# Altium schematic sheet phototransistors.SchDoc: Phototransostors (part 3 of 3)
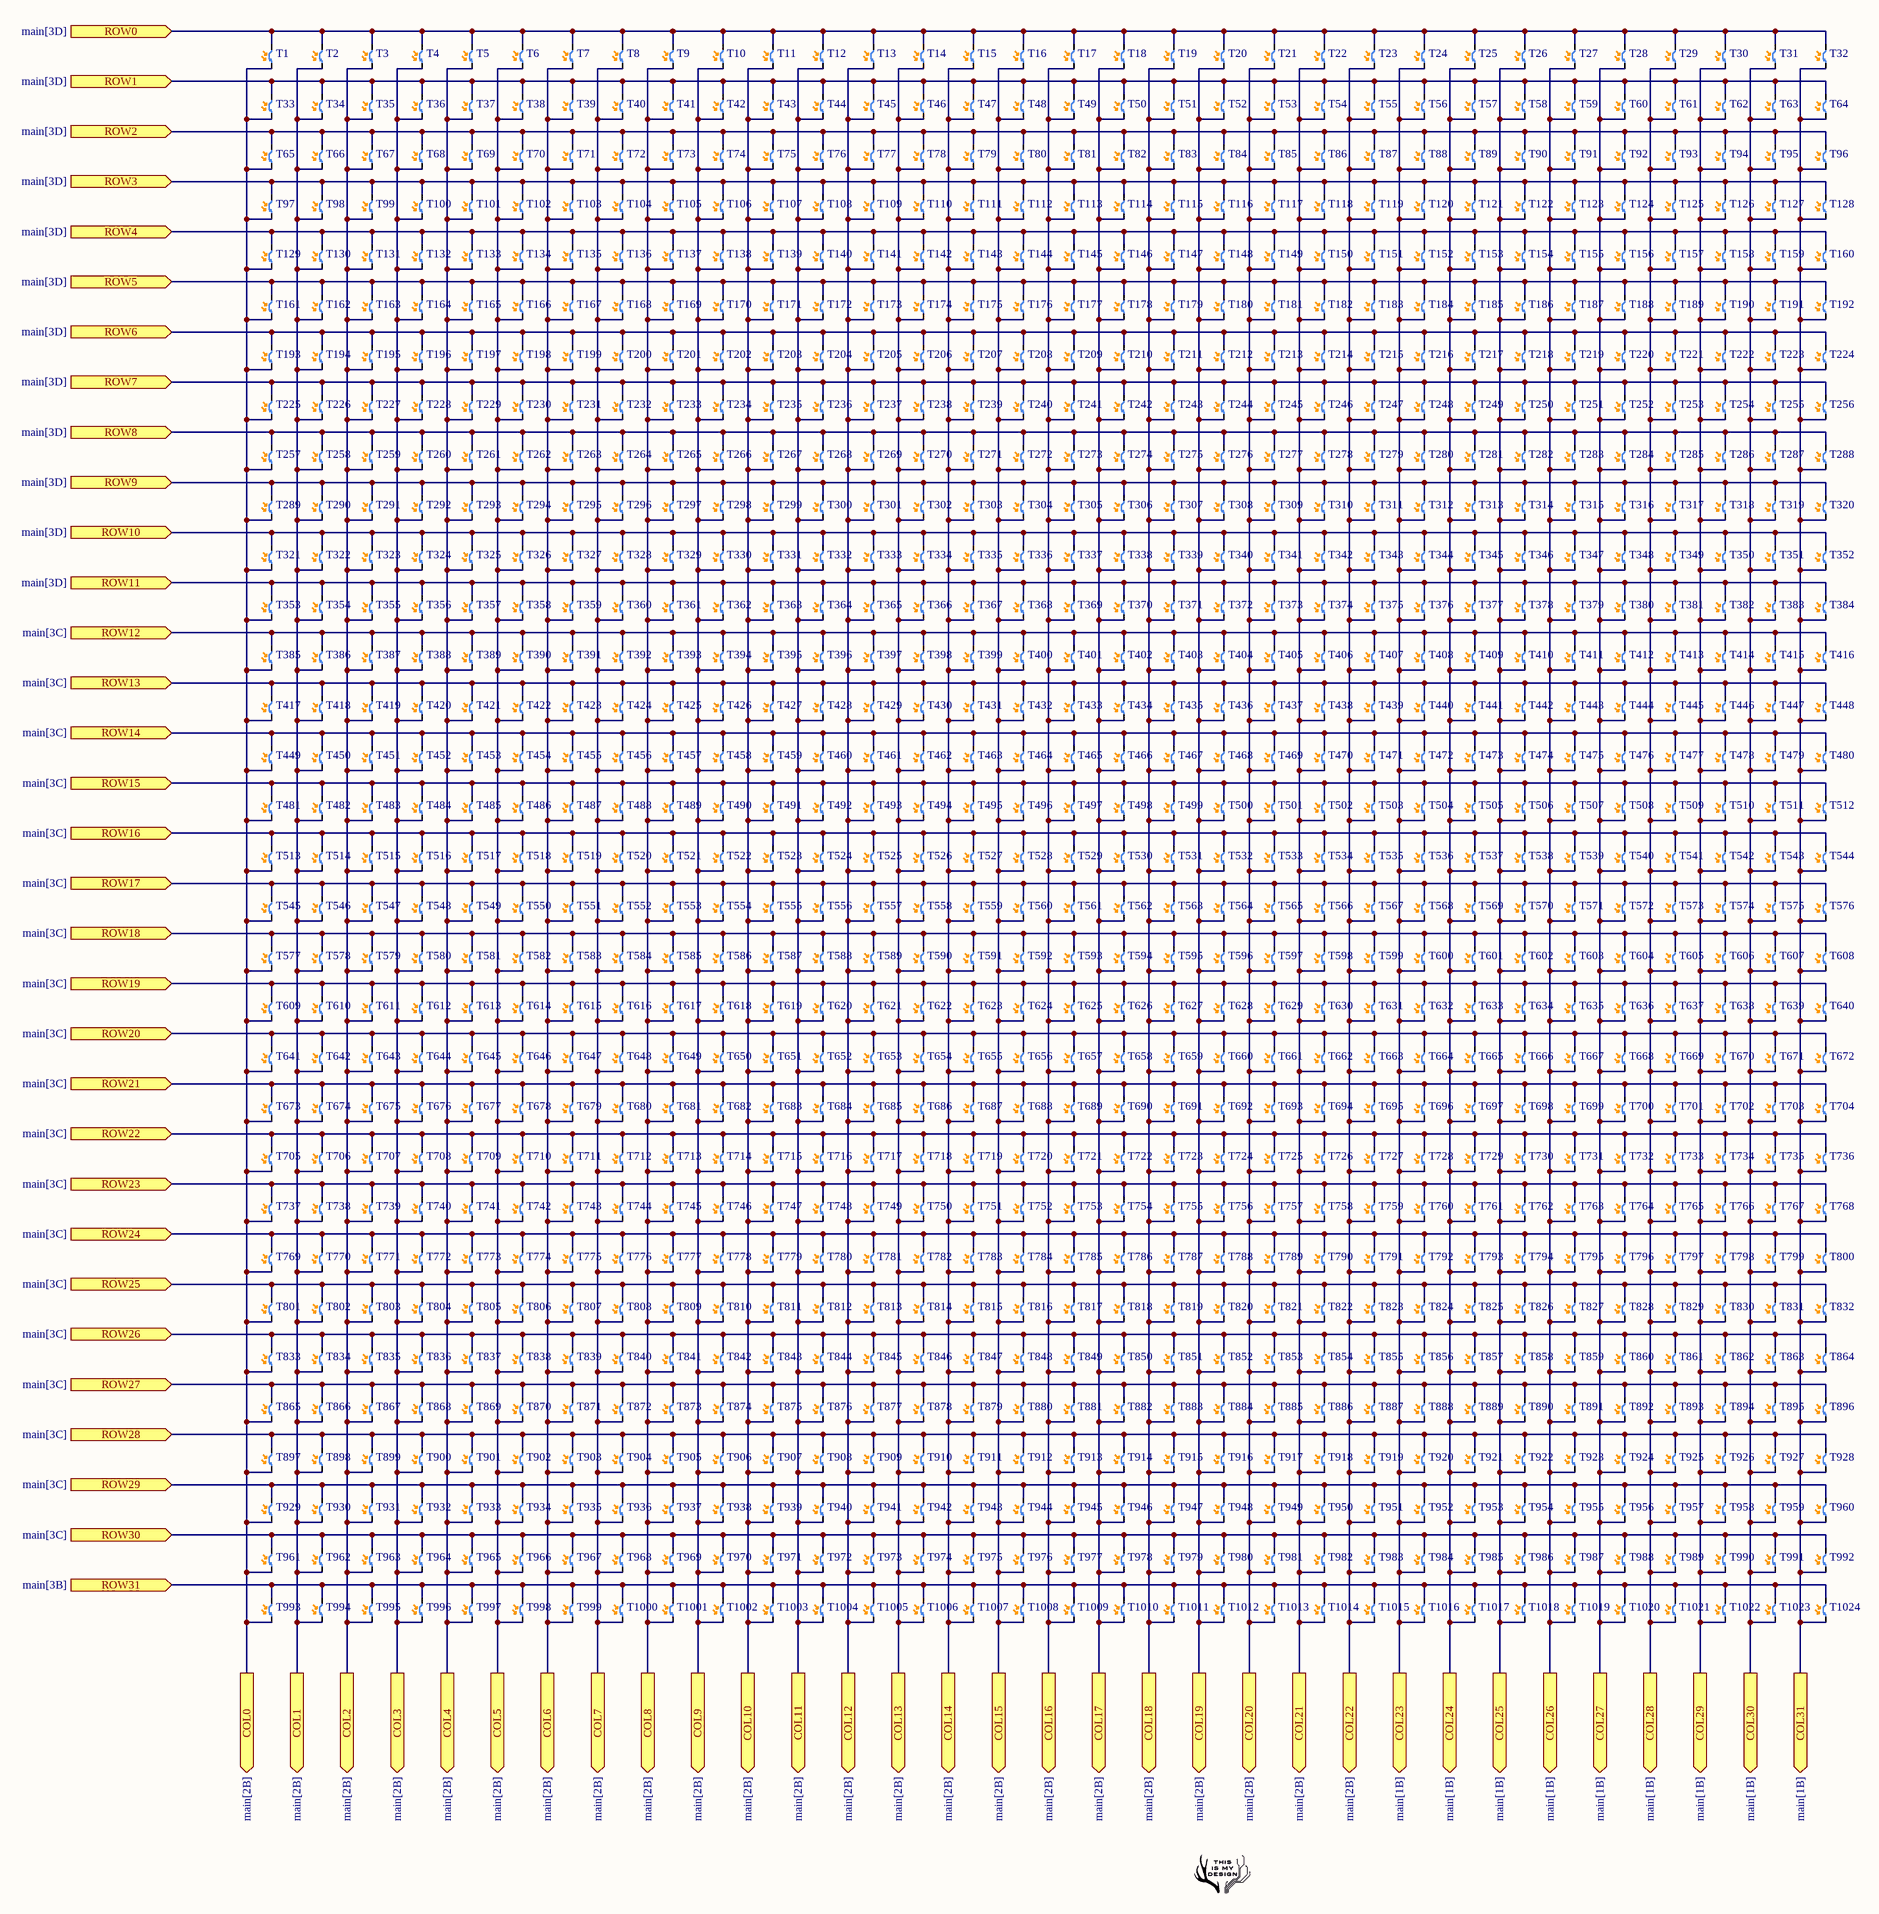
[diagram p2: phototransistors.SchDoc]

## Parts (continued)
T822  B19H1PT--H9C000214U1930  [LED0603W]  (value not drawn)
T823  B19H1PT--H9C000214U1930  [LED0603W]  (value not drawn)
T824  B19H1PT--H9C000214U1930  [LED0603W]  (value not drawn)
T825  B19H1PT--H9C000214U1930  [LED0603W]  (value not drawn)
T826  B19H1PT--H9C000214U1930  [LED0603W]  (value not drawn)
T827  B19H1PT--H9C000214U1930  [LED0603W]  (value not drawn)
T828  B19H1PT--H9C000214U1930  [LED0603W]  (value not drawn)
T829  B19H1PT--H9C000214U1930  [LED0603W]  (value not drawn)
T830  B19H1PT--H9C000214U1930  [LED0603W]  (value not drawn)
T831  B19H1PT--H9C000214U1930  [LED0603W]  (value not drawn)
T832  B19H1PT--H9C000214U1930  [LED0603W]  (value not drawn)
T833  B19H1PT--H9C000214U1930  [LED0603W]  (value not drawn)
T834  B19H1PT--H9C000214U1930  [LED0603W]  (value not drawn)
T835  B19H1PT--H9C000214U1930  [LED0603W]  (value not drawn)
T836  B19H1PT--H9C000214U1930  [LED0603W]  (value not drawn)
T837  B19H1PT--H9C000214U1930  [LED0603W]  (value not drawn)
T838  B19H1PT--H9C000214U1930  [LED0603W]  (value not drawn)
T839  B19H1PT--H9C000214U1930  [LED0603W]  (value not drawn)
T840  B19H1PT--H9C000214U1930  [LED0603W]  (value not drawn)
T841  B19H1PT--H9C000214U1930  [LED0603W]  (value not drawn)
T842  B19H1PT--H9C000214U1930  [LED0603W]  (value not drawn)
T843  B19H1PT--H9C000214U1930  [LED0603W]  (value not drawn)
T844  B19H1PT--H9C000214U1930  [LED0603W]  (value not drawn)
T845  B19H1PT--H9C000214U1930  [LED0603W]  (value not drawn)
T846  B19H1PT--H9C000214U1930  [LED0603W]  (value not drawn)
T847  B19H1PT--H9C000214U1930  [LED0603W]  (value not drawn)
T848  B19H1PT--H9C000214U1930  [LED0603W]  (value not drawn)
T849  B19H1PT--H9C000214U1930  [LED0603W]  (value not drawn)
T850  B19H1PT--H9C000214U1930  [LED0603W]  (value not drawn)
T851  B19H1PT--H9C000214U1930  [LED0603W]  (value not drawn)
T852  B19H1PT--H9C000214U1930  [LED0603W]  (value not drawn)
T853  B19H1PT--H9C000214U1930  [LED0603W]  (value not drawn)
T854  B19H1PT--H9C000214U1930  [LED0603W]  (value not drawn)
T855  B19H1PT--H9C000214U1930  [LED0603W]  (value not drawn)
T856  B19H1PT--H9C000214U1930  [LED0603W]  (value not drawn)
T857  B19H1PT--H9C000214U1930  [LED0603W]  (value not drawn)
T858  B19H1PT--H9C000214U1930  [LED0603W]  (value not drawn)
T859  B19H1PT--H9C000214U1930  [LED0603W]  (value not drawn)
T860  B19H1PT--H9C000214U1930  [LED0603W]  (value not drawn)
T861  B19H1PT--H9C000214U1930  [LED0603W]  (value not drawn)
T862  B19H1PT--H9C000214U1930  [LED0603W]  (value not drawn)
T863  B19H1PT--H9C000214U1930  [LED0603W]  (value not drawn)
T864  B19H1PT--H9C000214U1930  [LED0603W]  (value not drawn)
T865  B19H1PT--H9C000214U1930  [LED0603W]  (value not drawn)
T866  B19H1PT--H9C000214U1930  [LED0603W]  (value not drawn)
T867  B19H1PT--H9C000214U1930  [LED0603W]  (value not drawn)
T868  B19H1PT--H9C000214U1930  [LED0603W]  (value not drawn)
T869  B19H1PT--H9C000214U1930  [LED0603W]  (value not drawn)
T870  B19H1PT--H9C000214U1930  [LED0603W]  (value not drawn)
T871  B19H1PT--H9C000214U1930  [LED0603W]  (value not drawn)
T872  B19H1PT--H9C000214U1930  [LED0603W]  (value not drawn)
T873  B19H1PT--H9C000214U1930  [LED0603W]  (value not drawn)
T874  B19H1PT--H9C000214U1930  [LED0603W]  (value not drawn)
T875  B19H1PT--H9C000214U1930  [LED0603W]  (value not drawn)
T876  B19H1PT--H9C000214U1930  [LED0603W]  (value not drawn)
T877  B19H1PT--H9C000214U1930  [LED0603W]  (value not drawn)
T878  B19H1PT--H9C000214U1930  [LED0603W]  (value not drawn)
T879  B19H1PT--H9C000214U1930  [LED0603W]  (value not drawn)
T880  B19H1PT--H9C000214U1930  [LED0603W]  (value not drawn)
T881  B19H1PT--H9C000214U1930  [LED0603W]  (value not drawn)
T882  B19H1PT--H9C000214U1930  [LED0603W]  (value not drawn)
T883  B19H1PT--H9C000214U1930  [LED0603W]  (value not drawn)
T884  B19H1PT--H9C000214U1930  [LED0603W]  (value not drawn)
T885  B19H1PT--H9C000214U1930  [LED0603W]  (value not drawn)
T886  B19H1PT--H9C000214U1930  [LED0603W]  (value not drawn)
T887  B19H1PT--H9C000214U1930  [LED0603W]  (value not drawn)
T888  B19H1PT--H9C000214U1930  [LED0603W]  (value not drawn)
T889  B19H1PT--H9C000214U1930  [LED0603W]  (value not drawn)
T890  B19H1PT--H9C000214U1930  [LED0603W]  (value not drawn)
T891  B19H1PT--H9C000214U1930  [LED0603W]  (value not drawn)
T892  B19H1PT--H9C000214U1930  [LED0603W]  (value not drawn)
T893  B19H1PT--H9C000214U1930  [LED0603W]  (value not drawn)
T894  B19H1PT--H9C000214U1930  [LED0603W]  (value not drawn)
T895  B19H1PT--H9C000214U1930  [LED0603W]  (value not drawn)
T896  B19H1PT--H9C000214U1930  [LED0603W]  (value not drawn)
T897  B19H1PT--H9C000214U1930  [LED0603W]  (value not drawn)
T898  B19H1PT--H9C000214U1930  [LED0603W]  (value not drawn)
T899  B19H1PT--H9C000214U1930  [LED0603W]  (value not drawn)
T900  B19H1PT--H9C000214U1930  [LED0603W]  (value not drawn)
T901  B19H1PT--H9C000214U1930  [LED0603W]  (value not drawn)
T902  B19H1PT--H9C000214U1930  [LED0603W]  (value not drawn)
T903  B19H1PT--H9C000214U1930  [LED0603W]  (value not drawn)
T904  B19H1PT--H9C000214U1930  [LED0603W]  (value not drawn)
T905  B19H1PT--H9C000214U1930  [LED0603W]  (value not drawn)
T906  B19H1PT--H9C000214U1930  [LED0603W]  (value not drawn)
T907  B19H1PT--H9C000214U1930  [LED0603W]  (value not drawn)
T908  B19H1PT--H9C000214U1930  [LED0603W]  (value not drawn)
T909  B19H1PT--H9C000214U1930  [LED0603W]  (value not drawn)
T910  B19H1PT--H9C000214U1930  [LED0603W]  (value not drawn)
T911  B19H1PT--H9C000214U1930  [LED0603W]  (value not drawn)
T912  B19H1PT--H9C000214U1930  [LED0603W]  (value not drawn)
T913  B19H1PT--H9C000214U1930  [LED0603W]  (value not drawn)
T914  B19H1PT--H9C000214U1930  [LED0603W]  (value not drawn)
T915  B19H1PT--H9C000214U1930  [LED0603W]  (value not drawn)
T916  B19H1PT--H9C000214U1930  [LED0603W]  (value not drawn)
T917  B19H1PT--H9C000214U1930  [LED0603W]  (value not drawn)
T918  B19H1PT--H9C000214U1930  [LED0603W]  (value not drawn)
T919  B19H1PT--H9C000214U1930  [LED0603W]  (value not drawn)
T920  B19H1PT--H9C000214U1930  [LED0603W]  (value not drawn)
T921  B19H1PT--H9C000214U1930  [LED0603W]  (value not drawn)
T922  B19H1PT--H9C000214U1930  [LED0603W]  (value not drawn)
T923  B19H1PT--H9C000214U1930  [LED0603W]  (value not drawn)
T924  B19H1PT--H9C000214U1930  [LED0603W]  (value not drawn)
T925  B19H1PT--H9C000214U1930  [LED0603W]  (value not drawn)
T926  B19H1PT--H9C000214U1930  [LED0603W]  (value not drawn)
T927  B19H1PT--H9C000214U1930  [LED0603W]  (value not drawn)
T928  B19H1PT--H9C000214U1930  [LED0603W]  (value not drawn)
T929  B19H1PT--H9C000214U1930  [LED0603W]  (value not drawn)
T930  B19H1PT--H9C000214U1930  [LED0603W]  (value not drawn)
T931  B19H1PT--H9C000214U1930  [LED0603W]  (value not drawn)
T932  B19H1PT--H9C000214U1930  [LED0603W]  (value not drawn)
T933  B19H1PT--H9C000214U1930  [LED0603W]  (value not drawn)
T934  B19H1PT--H9C000214U1930  [LED0603W]  (value not drawn)
T935  B19H1PT--H9C000214U1930  [LED0603W]  (value not drawn)
T936  B19H1PT--H9C000214U1930  [LED0603W]  (value not drawn)
T937  B19H1PT--H9C000214U1930  [LED0603W]  (value not drawn)
T938  B19H1PT--H9C000214U1930  [LED0603W]  (value not drawn)
T939  B19H1PT--H9C000214U1930  [LED0603W]  (value not drawn)
T940  B19H1PT--H9C000214U1930  [LED0603W]  (value not drawn)
T941  B19H1PT--H9C000214U1930  [LED0603W]  (value not drawn)
T942  B19H1PT--H9C000214U1930  [LED0603W]  (value not drawn)
T943  B19H1PT--H9C000214U1930  [LED0603W]  (value not drawn)
T944  B19H1PT--H9C000214U1930  [LED0603W]  (value not drawn)
T945  B19H1PT--H9C000214U1930  [LED0603W]  (value not drawn)
T946  B19H1PT--H9C000214U1930  [LED0603W]  (value not drawn)
T947  B19H1PT--H9C000214U1930  [LED0603W]  (value not drawn)
T948  B19H1PT--H9C000214U1930  [LED0603W]  (value not drawn)
T949  B19H1PT--H9C000214U1930  [LED0603W]  (value not drawn)
T950  B19H1PT--H9C000214U1930  [LED0603W]  (value not drawn)
T951  B19H1PT--H9C000214U1930  [LED0603W]  (value not drawn)
T952  B19H1PT--H9C000214U1930  [LED0603W]  (value not drawn)
T953  B19H1PT--H9C000214U1930  [LED0603W]  (value not drawn)
T954  B19H1PT--H9C000214U1930  [LED0603W]  (value not drawn)
T955  B19H1PT--H9C000214U1930  [LED0603W]  (value not drawn)
T956  B19H1PT--H9C000214U1930  [LED0603W]  (value not drawn)
T957  B19H1PT--H9C000214U1930  [LED0603W]  (value not drawn)
T958  B19H1PT--H9C000214U1930  [LED0603W]  (value not drawn)
T959  B19H1PT--H9C000214U1930  [LED0603W]  (value not drawn)
T960  B19H1PT--H9C000214U1930  [LED0603W]  (value not drawn)
T961  B19H1PT--H9C000214U1930  [LED0603W]  (value not drawn)
T962  B19H1PT--H9C000214U1930  [LED0603W]  (value not drawn)
T963  B19H1PT--H9C000214U1930  [LED0603W]  (value not drawn)
T964  B19H1PT--H9C000214U1930  [LED0603W]  (value not drawn)
T965  B19H1PT--H9C000214U1930  [LED0603W]  (value not drawn)
T966  B19H1PT--H9C000214U1930  [LED0603W]  (value not drawn)
T967  B19H1PT--H9C000214U1930  [LED0603W]  (value not drawn)
T968  B19H1PT--H9C000214U1930  [LED0603W]  (value not drawn)
T969  B19H1PT--H9C000214U1930  [LED0603W]  (value not drawn)
T970  B19H1PT--H9C000214U1930  [LED0603W]  (value not drawn)
T971  B19H1PT--H9C000214U1930  [LED0603W]  (value not drawn)
T972  B19H1PT--H9C000214U1930  [LED0603W]  (value not drawn)
T973  B19H1PT--H9C000214U1930  [LED0603W]  (value not drawn)
T974  B19H1PT--H9C000214U1930  [LED0603W]  (value not drawn)
T975  B19H1PT--H9C000214U1930  [LED0603W]  (value not drawn)
T976  B19H1PT--H9C000214U1930  [LED0603W]  (value not drawn)
T977  B19H1PT--H9C000214U1930  [LED0603W]  (value not drawn)
T978  B19H1PT--H9C000214U1930  [LED0603W]  (value not drawn)
T979  B19H1PT--H9C000214U1930  [LED0603W]  (value not drawn)
T980  B19H1PT--H9C000214U1930  [LED0603W]  (value not drawn)
T981  B19H1PT--H9C000214U1930  [LED0603W]  (value not drawn)
T982  B19H1PT--H9C000214U1930  [LED0603W]  (value not drawn)
T983  B19H1PT--H9C000214U1930  [LED0603W]  (value not drawn)
T984  B19H1PT--H9C000214U1930  [LED0603W]  (value not drawn)
T985  B19H1PT--H9C000214U1930  [LED0603W]  (value not drawn)
T986  B19H1PT--H9C000214U1930  [LED0603W]  (value not drawn)
T987  B19H1PT--H9C000214U1930  [LED0603W]  (value not drawn)
T988  B19H1PT--H9C000214U1930  [LED0603W]  (value not drawn)
T989  B19H1PT--H9C000214U1930  [LED0603W]  (value not drawn)
T990  B19H1PT--H9C000214U1930  [LED0603W]  (value not drawn)
T991  B19H1PT--H9C000214U1930  [LED0603W]  (value not drawn)
T992  B19H1PT--H9C000214U1930  [LED0603W]  (value not drawn)
T993  B19H1PT--H9C000214U1930  [LED0603W]  (value not drawn)
T994  B19H1PT--H9C000214U1930  [LED0603W]  (value not drawn)
T995  B19H1PT--H9C000214U1930  [LED0603W]  (value not drawn)
T996  B19H1PT--H9C000214U1930  [LED0603W]  (value not drawn)
T997  B19H1PT--H9C000214U1930  [LED0603W]  (value not drawn)
T998  B19H1PT--H9C000214U1930  [LED0603W]  (value not drawn)
T999  B19H1PT--H9C000214U1930  [LED0603W]  (value not drawn)
T1000  B19H1PT--H9C000214U1930  [LED0603W]  (value not drawn)
T1001  B19H1PT--H9C000214U1930  [LED0603W]  (value not drawn)
T1002  B19H1PT--H9C000214U1930  [LED0603W]  (value not drawn)
T1003  B19H1PT--H9C000214U1930  [LED0603W]  (value not drawn)
T1004  B19H1PT--H9C000214U1930  [LED0603W]  (value not drawn)
T1005  B19H1PT--H9C000214U1930  [LED0603W]  (value not drawn)
T1006  B19H1PT--H9C000214U1930  [LED0603W]  (value not drawn)
T1007  B19H1PT--H9C000214U1930  [LED0603W]  (value not drawn)
T1008  B19H1PT--H9C000214U1930  [LED0603W]  (value not drawn)
T1009  B19H1PT--H9C000214U1930  [LED0603W]  (value not drawn)
T1010  B19H1PT--H9C000214U1930  [LED0603W]  (value not drawn)
T1011  B19H1PT--H9C000214U1930  [LED0603W]  (value not drawn)
T1012  B19H1PT--H9C000214U1930  [LED0603W]  (value not drawn)
T1013  B19H1PT--H9C000214U1930  [LED0603W]  (value not drawn)
T1014  B19H1PT--H9C000214U1930  [LED0603W]  (value not drawn)
T1015  B19H1PT--H9C000214U1930  [LED0603W]  (value not drawn)
T1016  B19H1PT--H9C000214U1930  [LED0603W]  (value not drawn)
T1017  B19H1PT--H9C000214U1930  [LED0603W]  (value not drawn)
T1018  B19H1PT--H9C000214U1930  [LED0603W]  (value not drawn)
T1019  B19H1PT--H9C000214U1930  [LED0603W]  (value not drawn)
T1020  B19H1PT--H9C000214U1930  [LED0603W]  (value not drawn)
T1021  B19H1PT--H9C000214U1930  [LED0603W]  (value not drawn)
T1022  B19H1PT--H9C000214U1930  [LED0603W]  (value not drawn)
T1023  B19H1PT--H9C000214U1930  [LED0603W]  (value not drawn)
T1024  B19H1PT--H9C000214U1930  [LED0603W]  (value not drawn)

## Ports
COL0 (out, see main[2B]), COL1 (out, see main[2B]), COL2 (out, see main[2B]), COL3 (out, see main[2B]), COL4 (out, see main[2B]), COL5 (out, see main[2B]), COL6 (out, see main[2B]), COL7 (out, see main[2B]), COL8 (out, see main[2B]), COL9 (out, see main[2B]), COL10 (out, see main[2B]), COL11 (out, see main[2B]), COL12 (out, see main[2B]), COL13 (out, see main[2B]), COL14 (out, see main[2B]), COL15 (out, see main[2B]), COL16 (out, see main[2B]), COL17 (out, see main[2B]), COL18 (out, see main[2B]), COL19 (out, see main[2B]), COL20 (out, see main[2B]), COL21 (out, see main[2B]), COL22 (out, see main[2B]), COL23 (out, see main[1B]), COL24 (out, see main[1B]), COL25 (out, see main[1B]), COL26 (out, see main[1B]), COL27 (out, see main[1B]), COL28 (out, see main[1B]), COL29 (out, see main[1B]), COL30 (out, see main[1B]), COL31 (out, see main[1B]), ROW0 (in, see main[3D]), ROW1 (in, see main[3D]), ROW2 (in, see main[3D]), ROW3 (in, see main[3D]), ROW4 (in, see main[3D]), ROW5 (in, see main[3D]), ROW6 (in, see main[3D]), ROW7 (in, see main[3D]), ROW8 (in, see main[3D]), ROW9 (in, see main[3D]), ROW10 (in, see main[3D]), ROW11 (in, see main[3D]), ROW12 (in, see main[3C]), ROW13 (in, see main[3C]), ROW14 (in, see main[3C]), ROW15 (in, see main[3C]), ROW16 (in, see main[3C]), ROW17 (in, see main[3C]), ROW18 (in, see main[3C]), ROW19 (in, see main[3C]), ROW20 (in, see main[3C]), ROW21 (in, see main[3C]), ROW22 (in, see main[3C]), ROW23 (in, see main[3C]), ROW24 (in, see main[3C]), ROW25 (in, see main[3C]), ROW26 (in, see main[3C]), ROW27 (in, see main[3C]), ROW28 (in, see main[3C]), ROW29 (in, see main[3C]), ROW30 (in, see main[3C]), ROW31 (in, see main[3B])

## Nets
COL0: T1.2(E) T33.2(E) T65.2(E) T97.2(E) T129.2(E) T161.2(E) T193.2(E) T225.2(E) T257.2(E) T289.2(E) T321.2(E) T353.2(E) T385.2(E) T417.2(E) T449.2(E) T481.2(E) T513.2(E) T545.2(E) T577.2(E) T609.2(E) T641.2(E) T673.2(E) T705.2(E) T737.2(E) T769.2(E) T801.2(E) T833.2(E) T865.2(E) T897.2(E) T929.2(E) T961.2(E) T993.2(E) ; port COL0
COL1: T2.2(E) T34.2(E) T66.2(E) T98.2(E) T130.2(E) T162.2(E) T194.2(E) T226.2(E) T258.2(E) T290.2(E) T322.2(E) T354.2(E) T386.2(E) T418.2(E) T450.2(E) T482.2(E) T514.2(E) T546.2(E) T578.2(E) T610.2(E) T642.2(E) T674.2(E) T706.2(E) T738.2(E) T770.2(E) T802.2(E) T834.2(E) T866.2(E) T898.2(E) T930.2(E) T962.2(E) T994.2(E) ; port COL1
COL2: T3.2(E) T35.2(E) T67.2(E) T99.2(E) T131.2(E) T163.2(E) T195.2(E) T227.2(E) T259.2(E) T291.2(E) T323.2(E) T355.2(E) T387.2(E) T419.2(E) T451.2(E) T483.2(E) T515.2(E) T547.2(E) T579.2(E) T611.2(E) T643.2(E) T675.2(E) T707.2(E) T739.2(E) T771.2(E) T803.2(E) T835.2(E) T867.2(E) T899.2(E) T931.2(E) T963.2(E) T995.2(E) ; port COL2
COL3: T4.2(E) T36.2(E) T68.2(E) T100.2(E) T132.2(E) T164.2(E) T196.2(E) T228.2(E) T260.2(E) T292.2(E) T324.2(E) T356.2(E) T388.2(E) T420.2(E) T452.2(E) T484.2(E) T516.2(E) T548.2(E) T580.2(E) T612.2(E) T644.2(E) T676.2(E) T708.2(E) T740.2(E) T772.2(E) T804.2(E) T836.2(E) T868.2(E) T900.2(E) T932.2(E) T964.2(E) T996.2(E) ; port COL3
COL4: T5.2(E) T37.2(E) T69.2(E) T101.2(E) T133.2(E) T165.2(E) T197.2(E) T229.2(E) T261.2(E) T293.2(E) T325.2(E) T357.2(E) T389.2(E) T421.2(E) T453.2(E) T485.2(E) T517.2(E) T549.2(E) T581.2(E) T613.2(E) T645.2(E) T677.2(E) T709.2(E) T741.2(E) T773.2(E) T805.2(E) T837.2(E) T869.2(E) T901.2(E) T933.2(E) T965.2(E) T997.2(E) ; port COL4
COL5: T6.2(E) T38.2(E) T70.2(E) T102.2(E) T134.2(E) T166.2(E) T198.2(E) T230.2(E) T262.2(E) T294.2(E) T326.2(E) T358.2(E) T390.2(E) T422.2(E) T454.2(E) T486.2(E) T518.2(E) T550.2(E) T582.2(E) T614.2(E) T646.2(E) T678.2(E) T710.2(E) T742.2(E) T774.2(E) T806.2(E) T838.2(E) T870.2(E) T902.2(E) T934.2(E) T966.2(E) T998.2(E) ; port COL5
COL6: T7.2(E) T39.2(E) T71.2(E) T103.2(E) T135.2(E) T167.2(E) T199.2(E) T231.2(E) T263.2(E) T295.2(E) T327.2(E) T359.2(E) T391.2(E) T423.2(E) T455.2(E) T487.2(E) T519.2(E) T551.2(E) T583.2(E) T615.2(E) T647.2(E) T679.2(E) T711.2(E) T743.2(E) T775.2(E) T807.2(E) T839.2(E) T871.2(E) T903.2(E) T935.2(E) T967.2(E) T999.2(E) ; port COL6
COL7: T8.2(E) T40.2(E) T72.2(E) T104.2(E) T136.2(E) T168.2(E) T200.2(E) T232.2(E) T264.2(E) T296.2(E) T328.2(E) T360.2(E) T392.2(E) T424.2(E) T456.2(E) T488.2(E) T520.2(E) T552.2(E) T584.2(E) T616.2(E) T648.2(E) T680.2(E) T712.2(E) T744.2(E) T776.2(E) T808.2(E) T840.2(E) T872.2(E) T904.2(E) T936.2(E) T968.2(E) T1000.2(E) ; port COL7
COL8: T9.2(E) T41.2(E) T73.2(E) T105.2(E) T137.2(E) T169.2(E) T201.2(E) T233.2(E) T265.2(E) T297.2(E) T329.2(E) T361.2(E) T393.2(E) T425.2(E) T457.2(E) T489.2(E) T521.2(E) T553.2(E) T585.2(E) T617.2(E) T649.2(E) T681.2(E) T713.2(E) T745.2(E) T777.2(E) T809.2(E) T841.2(E) T873.2(E) T905.2(E) T937.2(E) T969.2(E) T1001.2(E) ; port COL8
COL9: T10.2(E) T42.2(E) T74.2(E) T106.2(E) T138.2(E) T170.2(E) T202.2(E) T234.2(E) T266.2(E) T298.2(E) T330.2(E) T362.2(E) T394.2(E) T426.2(E) T458.2(E) T490.2(E) T522.2(E) T554.2(E) T586.2(E) T618.2(E) T650.2(E) T682.2(E) T714.2(E) T746.2(E) T778.2(E) T810.2(E) T842.2(E) T874.2(E) T906.2(E) T938.2(E) T970.2(E) T1002.2(E) ; port COL9
COL10: T11.2(E) T43.2(E) T75.2(E) T107.2(E) T139.2(E) T171.2(E) T203.2(E) T235.2(E) T267.2(E) T299.2(E) T331.2(E) T363.2(E) T395.2(E) T427.2(E) T459.2(E) T491.2(E) T523.2(E) T555.2(E) T587.2(E) T619.2(E) T651.2(E) T683.2(E) T715.2(E) T747.2(E) T779.2(E) T811.2(E) T843.2(E) T875.2(E) T907.2(E) T939.2(E) T971.2(E) T1003.2(E) ; port COL10
COL11: T12.2(E) T44.2(E) T76.2(E) T108.2(E) T140.2(E) T172.2(E) T204.2(E) T236.2(E) T268.2(E) T300.2(E) T332.2(E) T364.2(E) T396.2(E) T428.2(E) T460.2(E) T492.2(E) T524.2(E) T556.2(E) T588.2(E) T620.2(E) T652.2(E) T684.2(E) T716.2(E) T748.2(E) T780.2(E) T812.2(E) T844.2(E) T876.2(E) T908.2(E) T940.2(E) T972.2(E) T1004.2(E) ; port COL11
COL12: T13.2(E) T45.2(E) T77.2(E) T109.2(E) T141.2(E) T173.2(E) T205.2(E) T237.2(E) T269.2(E) T301.2(E) T333.2(E) T365.2(E) T397.2(E) T429.2(E) T461.2(E) T493.2(E) T525.2(E) T557.2(E) T589.2(E) T621.2(E) T653.2(E) T685.2(E) T717.2(E) T749.2(E) T781.2(E) T813.2(E) T845.2(E) T877.2(E) T909.2(E) T941.2(E) T973.2(E) T1005.2(E) ; port COL12
COL13: T14.2(E) T46.2(E) T78.2(E) T110.2(E) T142.2(E) T174.2(E) T206.2(E) T238.2(E) T270.2(E) T302.2(E) T334.2(E) T366.2(E) T398.2(E) T430.2(E) T462.2(E) T494.2(E) T526.2(E) T558.2(E) T590.2(E) T622.2(E) T654.2(E) T686.2(E) T718.2(E) T750.2(E) T782.2(E) T814.2(E) T846.2(E) T878.2(E) T910.2(E) T942.2(E) T974.2(E) T1006.2(E) ; port COL13
COL14: T15.2(E) T47.2(E) T79.2(E) T111.2(E) T143.2(E) T175.2(E) T207.2(E) T239.2(E) T271.2(E) T303.2(E) T335.2(E) T367.2(E) T399.2(E) T431.2(E) T463.2(E) T495.2(E) T527.2(E) T559.2(E) T591.2(E) T623.2(E) T655.2(E) T687.2(E) T719.2(E) T751.2(E) T783.2(E) T815.2(E) T847.2(E) T879.2(E) T911.2(E) T943.2(E) T975.2(E) T1007.2(E) ; port COL14
COL15: T16.2(E) T48.2(E) T80.2(E) T112.2(E) T144.2(E) T176.2(E) T208.2(E) T240.2(E) T272.2(E) T304.2(E) T336.2(E) T368.2(E) T400.2(E) T432.2(E) T464.2(E) T496.2(E) T528.2(E) T560.2(E) T592.2(E) T624.2(E) T656.2(E) T688.2(E) T720.2(E) T752.2(E) T784.2(E) T816.2(E) T848.2(E) T880.2(E) T912.2(E) T944.2(E) T976.2(E) T1008.2(E) ; port COL15
COL16: T17.2(E) T49.2(E) T81.2(E) T113.2(E) T145.2(E) T177.2(E) T209.2(E) T241.2(E) T273.2(E) T305.2(E) T337.2(E) T369.2(E) T401.2(E) T433.2(E) T465.2(E) T497.2(E) T529.2(E) T561.2(E) T593.2(E) T625.2(E) T657.2(E) T689.2(E) T721.2(E) T753.2(E) T785.2(E) T817.2(E) T849.2(E) T881.2(E) T913.2(E) T945.2(E) T977.2(E) T1009.2(E) ; port COL16
COL17: T18.2(E) T50.2(E) T82.2(E) T114.2(E) T146.2(E) T178.2(E) T210.2(E) T242.2(E) T274.2(E) T306.2(E) T338.2(E) T370.2(E) T402.2(E) T434.2(E) T466.2(E) T498.2(E) T530.2(E) T562.2(E) T594.2(E) T626.2(E) T658.2(E) T690.2(E) T722.2(E) T754.2(E) T786.2(E) T818.2(E) T850.2(E) T882.2(E) T914.2(E) T946.2(E) T978.2(E) T1010.2(E) ; port COL17
COL18: T19.2(E) T51.2(E) T83.2(E) T115.2(E) T147.2(E) T179.2(E) T211.2(E) T243.2(E) T275.2(E) T307.2(E) T339.2(E) T371.2(E) T403.2(E) T435.2(E) T467.2(E) T499.2(E) T531.2(E) T563.2(E) T595.2(E) T627.2(E) T659.2(E) T691.2(E) T723.2(E) T755.2(E) T787.2(E) T819.2(E) T851.2(E) T883.2(E) T915.2(E) T947.2(E) T979.2(E) T1011.2(E) ; port COL18
COL19: T20.2(E) T52.2(E) T84.2(E) T116.2(E) T148.2(E) T180.2(E) T212.2(E) T244.2(E) T276.2(E) T308.2(E) T340.2(E) T372.2(E) T404.2(E) T436.2(E) T468.2(E) T500.2(E) T532.2(E) T564.2(E) T596.2(E) T628.2(E) T660.2(E) T692.2(E) T724.2(E) T756.2(E) T788.2(E) T820.2(E) T852.2(E) T884.2(E) T916.2(E) T948.2(E) T980.2(E) T1012.2(E) ; port COL19
COL20: T21.2(E) T53.2(E) T85.2(E) T117.2(E) T149.2(E) T181.2(E) T213.2(E) T245.2(E) T277.2(E) T309.2(E) T341.2(E) T373.2(E) T405.2(E) T437.2(E) T469.2(E) T501.2(E) T533.2(E) T565.2(E) T597.2(E) T629.2(E) T661.2(E) T693.2(E) T725.2(E) T757.2(E) T789.2(E) T821.2(E) T853.2(E) T885.2(E) T917.2(E) T949.2(E) T981.2(E) T1013.2(E) ; port COL20
COL21: T22.2(E) T54.2(E) T86.2(E) T118.2(E) T150.2(E) T182.2(E) T214.2(E) T246.2(E) T278.2(E) T310.2(E) T342.2(E) T374.2(E) T406.2(E) T438.2(E) T470.2(E) T502.2(E) T534.2(E) T566.2(E) T598.2(E) T630.2(E) T662.2(E) T694.2(E) T726.2(E) T758.2(E) T790.2(E) T822.2(E) T854.2(E) T886.2(E) T918.2(E) T950.2(E) T982.2(E) T1014.2(E) ; port COL21
COL22: T23.2(E) T55.2(E) T87.2(E) T119.2(E) T151.2(E) T183.2(E) T215.2(E) T247.2(E) T279.2(E) T311.2(E) T343.2(E) T375.2(E) T407.2(E) T439.2(E) T471.2(E) T503.2(E) T535.2(E) T567.2(E) T599.2(E) T631.2(E) T663.2(E) T695.2(E) T727.2(E) T759.2(E) T791.2(E) T823.2(E) T855.2(E) T887.2(E) T919.2(E) T951.2(E) T983.2(E) T1015.2(E) ; port COL22
COL23: T24.2(E) T56.2(E) T88.2(E) T120.2(E) T152.2(E) T184.2(E) T216.2(E) T248.2(E) T280.2(E) T312.2(E) T344.2(E) T376.2(E) T408.2(E) T440.2(E) T472.2(E) T504.2(E) T536.2(E) T568.2(E) T600.2(E) T632.2(E) T664.2(E) T696.2(E) T728.2(E) T760.2(E) T792.2(E) T824.2(E) T856.2(E) T888.2(E) T920.2(E) T952.2(E) T984.2(E) T1016.2(E) ; port COL23
COL24: T25.2(E) T57.2(E) T89.2(E) T121.2(E) T153.2(E) T185.2(E) T217.2(E) T249.2(E) T281.2(E) T313.2(E) T345.2(E) T377.2(E) T409.2(E) T441.2(E) T473.2(E) T505.2(E) T537.2(E) T569.2(E) T601.2(E) T633.2(E) T665.2(E) T697.2(E) T729.2(E) T761.2(E) T793.2(E) T825.2(E) T857.2(E) T889.2(E) T921.2(E) T953.2(E) T985.2(E) T1017.2(E) ; port COL24
COL25: T26.2(E) T58.2(E) T90.2(E) T122.2(E) T154.2(E) T186.2(E) T218.2(E) T250.2(E) T282.2(E) T314.2(E) T346.2(E) T378.2(E) T410.2(E) T442.2(E) T474.2(E) T506.2(E) T538.2(E) T570.2(E) T602.2(E) T634.2(E) T666.2(E) T698.2(E) T730.2(E) T762.2(E) T794.2(E) T826.2(E) T858.2(E) T890.2(E) T922.2(E) T954.2(E) T986.2(E) T1018.2(E) ; port COL25
COL26: T27.2(E) T59.2(E) T91.2(E) T123.2(E) T155.2(E) T187.2(E) T219.2(E) T251.2(E) T283.2(E) T315.2(E) T347.2(E) T379.2(E) T411.2(E) T443.2(E) T475.2(E) T507.2(E) T539.2(E) T571.2(E) T603.2(E) T635.2(E) T667.2(E) T699.2(E) T731.2(E) T763.2(E) T795.2(E) T827.2(E) T859.2(E) T891.2(E) T923.2(E) T955.2(E) T987.2(E) T1019.2(E) ; port COL26
COL27: T28.2(E) T60.2(E) T92.2(E) T124.2(E) T156.2(E) T188.2(E) T220.2(E) T252.2(E) T284.2(E) T316.2(E) T348.2(E) T380.2(E) T412.2(E) T444.2(E) T476.2(E) T508.2(E) T540.2(E) T572.2(E) T604.2(E) T636.2(E) T668.2(E) T700.2(E) T732.2(E) T764.2(E) T796.2(E) T828.2(E) T860.2(E) T892.2(E) T924.2(E) T956.2(E) T988.2(E) T1020.2(E) ; port COL27
COL28: T29.2(E) T61.2(E) T93.2(E) T125.2(E) T157.2(E) T189.2(E) T221.2(E) T253.2(E) T285.2(E) T317.2(E) T349.2(E) T381.2(E) T413.2(E) T445.2(E) T477.2(E) T509.2(E) T541.2(E) T573.2(E) T605.2(E) T637.2(E) T669.2(E) T701.2(E) T733.2(E) T765.2(E) T797.2(E) T829.2(E) T861.2(E) T893.2(E) T925.2(E) T957.2(E) T989.2(E) T1021.2(E) ; port COL28
COL29: T30.2(E) T62.2(E) T94.2(E) T126.2(E) T158.2(E) T190.2(E) T222.2(E) T254.2(E) T286.2(E) T318.2(E) T350.2(E) T382.2(E) T414.2(E) T446.2(E) T478.2(E) T510.2(E) T542.2(E) T574.2(E) T606.2(E) T638.2(E) T670.2(E) T702.2(E) T734.2(E) T766.2(E) T798.2(E) T830.2(E) T862.2(E) T894.2(E) T926.2(E) T958.2(E) T990.2(E) T1022.2(E) ; port COL29
COL30: T31.2(E) T63.2(E) T95.2(E) T127.2(E) T159.2(E) T191.2(E) T223.2(E) T255.2(E) T287.2(E) T319.2(E) T351.2(E) T383.2(E) T415.2(E) T447.2(E) T479.2(E) T511.2(E) T543.2(E) T575.2(E) T607.2(E) T639.2(E) T671.2(E) T703.2(E) T735.2(E) T767.2(E) T799.2(E) T831.2(E) T863.2(E) T895.2(E) T927.2(E) T959.2(E) T991.2(E) T1023.2(E) ; port COL30
COL31: T32.2(E) T64.2(E) T96.2(E) T128.2(E) T160.2(E) T192.2(E) T224.2(E) T256.2(E) T288.2(E) T320.2(E) T352.2(E) T384.2(E) T416.2(E) T448.2(E) T480.2(E) T512.2(E) T544.2(E) T576.2(E) T608.2(E) T640.2(E) T672.2(E) T704.2(E) T736.2(E) T768.2(E) T800.2(E) T832.2(E) T864.2(E) T896.2(E) T928.2(E) T960.2(E) T992.2(E) T1024.2(E) ; port COL31
ROW0: T1.1(C) T2.1(C) T3.1(C) T4.1(C) T5.1(C) T6.1(C) T7.1(C) T8.1(C) T9.1(C) T10.1(C) T11.1(C) T12.1(C) T13.1(C) T14.1(C) T15.1(C) T16.1(C) T17.1(C) T18.1(C) T19.1(C) T20.1(C) T21.1(C) T22.1(C) T23.1(C) T24.1(C) T25.1(C) T26.1(C) T27.1(C) T28.1(C) T29.1(C) T30.1(C) T31.1(C) T32.1(C) ; port ROW0
ROW1: T33.1(C) T34.1(C) T35.1(C) T36.1(C) T37.1(C) T38.1(C) T39.1(C) T40.1(C) T41.1(C) T42.1(C) T43.1(C) T44.1(C) T45.1(C) T46.1(C) T47.1(C) T48.1(C) T49.1(C) T50.1(C) T51.1(C) T52.1(C) T53.1(C) T54.1(C) T55.1(C) T56.1(C) T57.1(C) T58.1(C) T59.1(C) T60.1(C) T61.1(C) T62.1(C) T63.1(C) T64.1(C) ; port ROW1
ROW2: T65.1(C) T66.1(C) T67.1(C) T68.1(C) T69.1(C) T70.1(C) T71.1(C) T72.1(C) T73.1(C) T74.1(C) T75.1(C) T76.1(C) T77.1(C) T78.1(C) T79.1(C) T80.1(C) T81.1(C) T82.1(C) T83.1(C) T84.1(C) T85.1(C) T86.1(C) T87.1(C) T88.1(C) T89.1(C) T90.1(C) T91.1(C) T92.1(C) T93.1(C) T94.1(C) T95.1(C) T96.1(C) ; port ROW2
ROW3: T97.1(C) T98.1(C) T99.1(C) T100.1(C) T101.1(C) T102.1(C) T103.1(C) T104.1(C) T105.1(C) T106.1(C) T107.1(C) T108.1(C) T109.1(C) T110.1(C) T111.1(C) T112.1(C) T113.1(C) T114.1(C) T115.1(C) T116.1(C) T117.1(C) T118.1(C) T119.1(C) T120.1(C) T121.1(C) T122.1(C) T123.1(C) T124.1(C) T125.1(C) T126.1(C) T127.1(C) T128.1(C) ; port ROW3
ROW4: T129.1(C) T130.1(C) T131.1(C) T132.1(C) T133.1(C) T134.1(C) T135.1(C) T136.1(C) T137.1(C) T138.1(C) T139.1(C) T140.1(C) T141.1(C) T142.1(C) T143.1(C) T144.1(C) T145.1(C) T146.1(C) T147.1(C) T148.1(C) T149.1(C) T150.1(C) T151.1(C) T152.1(C) T153.1(C) T154.1(C) T155.1(C) T156.1(C) T157.1(C) T158.1(C) T159.1(C) T160.1(C) ; port ROW4
ROW5: T161.1(C) T162.1(C) T163.1(C) T164.1(C) T165.1(C) T166.1(C) T167.1(C) T168.1(C) T169.1(C) T170.1(C) T171.1(C) T172.1(C) T173.1(C) T174.1(C) T175.1(C) T176.1(C) T177.1(C) T178.1(C) T179.1(C) T180.1(C) T181.1(C) T182.1(C) T183.1(C) T184.1(C) T185.1(C) T186.1(C) T187.1(C) T188.1(C) T189.1(C) T190.1(C) T191.1(C) T192.1(C) ; port ROW5
ROW6: T193.1(C) T194.1(C) T195.1(C) T196.1(C) T197.1(C) T198.1(C) T199.1(C) T200.1(C) T201.1(C) T202.1(C) T203.1(C) T204.1(C) T205.1(C) T206.1(C) T207.1(C) T208.1(C) T209.1(C) T210.1(C) T211.1(C) T212.1(C) T213.1(C) T214.1(C) T215.1(C) T216.1(C) T217.1(C) T218.1(C) T219.1(C) T220.1(C) T221.1(C) T222.1(C) T223.1(C) T224.1(C) ; port ROW6
ROW7: T225.1(C) T226.1(C) T227.1(C) T228.1(C) T229.1(C) T230.1(C) T231.1(C) T232.1(C) T233.1(C) T234.1(C) T235.1(C) T236.1(C) T237.1(C) T238.1(C) T239.1(C) T240.1(C) T241.1(C) T242.1(C) T243.1(C) T244.1(C) T245.1(C) T246.1(C) T247.1(C) T248.1(C) T249.1(C) T250.1(C) T251.1(C) T252.1(C) T253.1(C) T254.1(C) T255.1(C) T256.1(C) ; port ROW7
ROW8: T257.1(C) T258.1(C) T259.1(C) T260.1(C) T261.1(C) T262.1(C) T263.1(C) T264.1(C) T265.1(C) T266.1(C) T267.1(C) T268.1(C) T269.1(C) T270.1(C) T271.1(C) T272.1(C) T273.1(C) T274.1(C) T275.1(C) T276.1(C) T277.1(C) T278.1(C) T279.1(C) T280.1(C) T281.1(C) T282.1(C) T283.1(C) T284.1(C) T285.1(C) T286.1(C) T287.1(C) T288.1(C) ; port ROW8
ROW9: T289.1(C) T290.1(C) T291.1(C) T292.1(C) T293.1(C) T294.1(C) T295.1(C) T296.1(C) T297.1(C) T298.1(C) T299.1(C) T300.1(C) T301.1(C) T302.1(C) T303.1(C) T304.1(C) T305.1(C) T306.1(C) T307.1(C) T308.1(C) T309.1(C) T310.1(C) T311.1(C) T312.1(C) T313.1(C) T314.1(C) T315.1(C) T316.1(C) T317.1(C) T318.1(C) T319.1(C) T320.1(C) ; port ROW9
ROW10: T321.1(C) T322.1(C) T323.1(C) T324.1(C) T325.1(C) T326.1(C) T327.1(C) T328.1(C) T329.1(C) T330.1(C) T331.1(C) T332.1(C) T333.1(C) T334.1(C) T335.1(C) T336.1(C) T337.1(C) T338.1(C) T339.1(C) T340.1(C) T341.1(C) T342.1(C) T343.1(C) T344.1(C) T345.1(C) T346.1(C) T347.1(C) T348.1(C) T349.1(C) T350.1(C) T351.1(C) T352.1(C) ; port ROW10
ROW11: T353.1(C) T354.1(C) T355.1(C) T356.1(C) T357.1(C) T358.1(C) T359.1(C) T360.1(C) T361.1(C) T362.1(C) T363.1(C) T364.1(C) T365.1(C) T366.1(C) T367.1(C) T368.1(C) T369.1(C) T370.1(C) T371.1(C) T372.1(C) T373.1(C) T374.1(C) T375.1(C) T376.1(C) T377.1(C) T378.1(C) T379.1(C) T380.1(C) T381.1(C) T382.1(C) T383.1(C) T384.1(C) ; port ROW11
ROW12: T385.1(C) T386.1(C) T387.1(C) T388.1(C) T389.1(C) T390.1(C) T391.1(C) T392.1(C) T393.1(C) T394.1(C) T395.1(C) T396.1(C) T397.1(C) T398.1(C) T399.1(C) T400.1(C) T401.1(C) T402.1(C) T403.1(C) T404.1(C) T405.1(C) T406.1(C) T407.1(C) T408.1(C) T409.1(C) T410.1(C) T411.1(C) T412.1(C) T413.1(C) T414.1(C) T415.1(C) T416.1(C) ; port ROW12
ROW13: T417.1(C) T418.1(C) T419.1(C) T420.1(C) T421.1(C) T422.1(C) T423.1(C) T424.1(C) T425.1(C) T426.1(C) T427.1(C) T428.1(C) T429.1(C) T430.1(C) T431.1(C) T432.1(C) T433.1(C) T434.1(C) T435.1(C) T436.1(C) T437.1(C) T438.1(C) T439.1(C) T440.1(C) T441.1(C) T442.1(C) T443.1(C) T444.1(C) T445.1(C) T446.1(C) T447.1(C) T448.1(C) ; port ROW13
ROW14: T449.1(C) T450.1(C) T451.1(C) T452.1(C) T453.1(C) T454.1(C) T455.1(C) T456.1(C) T457.1(C) T458.1(C) T459.1(C) T460.1(C) T461.1(C) T462.1(C) T463.1(C) T464.1(C) T465.1(C) T466.1(C) T467.1(C) T468.1(C) T469.1(C) T470.1(C) T471.1(C) T472.1(C) T473.1(C) T474.1(C) T475.1(C) T476.1(C) T477.1(C) T478.1(C) T479.1(C) T480.1(C) ; port ROW14
ROW15: T481.1(C) T482.1(C) T483.1(C) T484.1(C) T485.1(C) T486.1(C) T487.1(C) T488.1(C) T489.1(C) T490.1(C) T491.1(C) T492.1(C) T493.1(C) T494.1(C) T495.1(C) T496.1(C) T497.1(C) T498.1(C) T499.1(C) T500.1(C) T501.1(C) T502.1(C) T503.1(C) T504.1(C) T505.1(C) T506.1(C) T507.1(C) T508.1(C) T509.1(C) T510.1(C) T511.1(C) T512.1(C) ; port ROW15
ROW16: T513.1(C) T514.1(C) T515.1(C) T516.1(C) T517.1(C) T518.1(C) T519.1(C) T520.1(C) T521.1(C) T522.1(C) T523.1(C) T524.1(C) T525.1(C) T526.1(C) T527.1(C) T528.1(C) T529.1(C) T530.1(C) T531.1(C) T532.1(C) T533.1(C) T534.1(C) T535.1(C) T536.1(C) T537.1(C) T538.1(C) T539.1(C) T540.1(C) T541.1(C) T542.1(C) T543.1(C) T544.1(C) ; port ROW16
ROW17: T545.1(C) T546.1(C) T547.1(C) T548.1(C) T549.1(C) T550.1(C) T551.1(C) T552.1(C) T553.1(C) T554.1(C) T555.1(C) T556.1(C) T557.1(C) T558.1(C) T559.1(C) T560.1(C) T561.1(C) T562.1(C) T563.1(C) T564.1(C) T565.1(C) T566.1(C) T567.1(C) T568.1(C) T569.1(C) T570.1(C) T571.1(C) T572.1(C) T573.1(C) T574.1(C) T575.1(C) T576.1(C) ; port ROW17
ROW18: T577.1(C) T578.1(C) T579.1(C) T580.1(C) T581.1(C) T582.1(C) T583.1(C) T584.1(C) T585.1(C) T586.1(C) T587.1(C) T588.1(C) T589.1(C) T590.1(C) T591.1(C) T592.1(C) T593.1(C) T594.1(C) T595.1(C) T596.1(C) T597.1(C) T598.1(C) T599.1(C) T600.1(C) T601.1(C) T602.1(C) T603.1(C) T604.1(C) T605.1(C) T606.1(C) T607.1(C) T608.1(C) ; port ROW18
ROW19: T609.1(C) T610.1(C) T611.1(C) T612.1(C) T613.1(C) T614.1(C) T615.1(C) T616.1(C) T617.1(C) T618.1(C) T619.1(C) T620.1(C) T621.1(C) T622.1(C) T623.1(C) T624.1(C) T625.1(C) T626.1(C) T627.1(C) T628.1(C) T629.1(C) T630.1(C) T631.1(C) T632.1(C) T633.1(C) T634.1(C) T635.1(C) T636.1(C) T637.1(C) T638.1(C) T639.1(C) T640.1(C) ; port ROW19
ROW20: T641.1(C) T642.1(C) T643.1(C) T644.1(C) T645.1(C) T646.1(C) T647.1(C) T648.1(C) T649.1(C) T650.1(C) T651.1(C) T652.1(C) T653.1(C) T654.1(C) T655.1(C) T656.1(C) T657.1(C) T658.1(C) T659.1(C) T660.1(C) T661.1(C) T662.1(C) T663.1(C) T664.1(C) T665.1(C) T666.1(C) T667.1(C) T668.1(C) T669.1(C) T670.1(C) T671.1(C) T672.1(C) ; port ROW20
ROW21: T673.1(C) T674.1(C) T675.1(C) T676.1(C) T677.1(C) T678.1(C) T679.1(C) T680.1(C) T681.1(C) T682.1(C) T683.1(C) T684.1(C) T685.1(C) T686.1(C) T687.1(C) T688.1(C) T689.1(C) T690.1(C) T691.1(C) T692.1(C) T693.1(C) T694.1(C) T695.1(C) T696.1(C) T697.1(C) T698.1(C) T699.1(C) T700.1(C) T701.1(C) T702.1(C) T703.1(C) T704.1(C) ; port ROW21
ROW22: T705.1(C) T706.1(C) T707.1(C) T708.1(C) T709.1(C) T710.1(C) T711.1(C) T712.1(C) T713.1(C) T714.1(C) T715.1(C) T716.1(C) T717.1(C) T718.1(C) T719.1(C) T720.1(C) T721.1(C) T722.1(C) T723.1(C) T724.1(C) T725.1(C) T726.1(C) T727.1(C) T728.1(C) T729.1(C) T730.1(C) T731.1(C) T732.1(C) T733.1(C) T734.1(C) T735.1(C) T736.1(C) ; port ROW22
ROW23: T737.1(C) T738.1(C) T739.1(C) T740.1(C) T741.1(C) T742.1(C) T743.1(C) T744.1(C) T745.1(C) T746.1(C) T747.1(C) T748.1(C) T749.1(C) T750.1(C) T751.1(C) T752.1(C) T753.1(C) T754.1(C) T755.1(C) T756.1(C) T757.1(C) T758.1(C) T759.1(C) T760.1(C) T761.1(C) T762.1(C) T763.1(C) T764.1(C) T765.1(C) T766.1(C) T767.1(C) T768.1(C) ; port ROW23
ROW24: T769.1(C) T770.1(C) T771.1(C) T772.1(C) T773.1(C) T774.1(C) T775.1(C) T776.1(C) T777.1(C) T778.1(C) T779.1(C) T780.1(C) T781.1(C) T782.1(C) T783.1(C) T784.1(C) T785.1(C) T786.1(C) T787.1(C) T788.1(C) T789.1(C) T790.1(C) T791.1(C) T792.1(C) T793.1(C) T794.1(C) T795.1(C) T796.1(C) T797.1(C) T798.1(C) T799.1(C) T800.1(C) ; port ROW24
ROW25: T801.1(C) T802.1(C) T803.1(C) T804.1(C) T805.1(C) T806.1(C) T807.1(C) T808.1(C) T809.1(C) T810.1(C) T811.1(C) T812.1(C) T813.1(C) T814.1(C) T815.1(C) T816.1(C) T817.1(C) T818.1(C) T819.1(C) T820.1(C) T821.1(C) T822.1(C) T823.1(C) T824.1(C) T825.1(C) T826.1(C) T827.1(C) T828.1(C) T829.1(C) T830.1(C) T831.1(C) T832.1(C) ; port ROW25
ROW26: T833.1(C) T834.1(C) T835.1(C) T836.1(C) T837.1(C) T838.1(C) T839.1(C) T840.1(C) T841.1(C) T842.1(C) T843.1(C) T844.1(C) T845.1(C) T846.1(C) T847.1(C) T848.1(C) T849.1(C) T850.1(C) T851.1(C) T852.1(C) T853.1(C) T854.1(C) T855.1(C) T856.1(C) T857.1(C) T858.1(C) T859.1(C) T860.1(C) T861.1(C) T862.1(C) T863.1(C) T864.1(C) ; port ROW26
ROW27: T865.1(C) T866.1(C) T867.1(C) T868.1(C) T869.1(C) T870.1(C) T871.1(C) T872.1(C) T873.1(C) T874.1(C) T875.1(C) T876.1(C) T877.1(C) T878.1(C) T879.1(C) T880.1(C) T881.1(C) T882.1(C) T883.1(C) T884.1(C) T885.1(C) T886.1(C) T887.1(C) T888.1(C) T889.1(C) T890.1(C) T891.1(C) T892.1(C) T893.1(C) T894.1(C) T895.1(C) T896.1(C) ; port ROW27
ROW28: T897.1(C) T898.1(C) T899.1(C) T900.1(C) T901.1(C) T902.1(C) T903.1(C) T904.1(C) T905.1(C) T906.1(C) T907.1(C) T908.1(C) T909.1(C) T910.1(C) T911.1(C) T912.1(C) T913.1(C) T914.1(C) T915.1(C) T916.1(C) T917.1(C) T918.1(C) T919.1(C) T920.1(C) T921.1(C) T922.1(C) T923.1(C) T924.1(C) T925.1(C) T926.1(C) T927.1(C) T928.1(C) ; port ROW28
ROW29: T929.1(C) T930.1(C) T931.1(C) T932.1(C) T933.1(C) T934.1(C) T935.1(C) T936.1(C) T937.1(C) T938.1(C) T939.1(C) T940.1(C) T941.1(C) T942.1(C) T943.1(C) T944.1(C) T945.1(C) T946.1(C) T947.1(C) T948.1(C) T949.1(C) T950.1(C) T951.1(C) T952.1(C) T953.1(C) T954.1(C) T955.1(C) T956.1(C) T957.1(C) T958.1(C) T959.1(C) T960.1(C) ; port ROW29
ROW30: T961.1(C) T962.1(C) T963.1(C) T964.1(C) T965.1(C) T966.1(C) T967.1(C) T968.1(C) T969.1(C) T970.1(C) T971.1(C) T972.1(C) T973.1(C) T974.1(C) T975.1(C) T976.1(C) T977.1(C) T978.1(C) T979.1(C) T980.1(C) T981.1(C) T982.1(C) T983.1(C) T984.1(C) T985.1(C) T986.1(C) T987.1(C) T988.1(C) T989.1(C) T990.1(C) T991.1(C) T992.1(C) ; port ROW30
ROW31: T993.1(C) T994.1(C) T995.1(C) T996.1(C) T997.1(C) T998.1(C) T999.1(C) T1000.1(C) T1001.1(C) T1002.1(C) T1003.1(C) T1004.1(C) T1005.1(C) T1006.1(C) T1007.1(C) T1008.1(C) T1009.1(C) T1010.1(C) T1011.1(C) T1012.1(C) T1013.1(C) T1014.1(C) T1015.1(C) T1016.1(C) T1017.1(C) T1018.1(C) T1019.1(C) T1020.1(C) T1021.1(C) T1022.1(C) T1023.1(C) T1024.1(C) ; port ROW31

## Notes on the sheet
- TITLE
- DESIGNER
- PRODUCT NUMBER
- SHEET VERSION
- LAST MODIFIED
- SHEET
- OF

## Library data of the parts
T1-T1024 = phototransistor